# EasyEDA Pro project Access Control Core.eprj, schematic Card Reader

## Sheets
1 NFC Reader: Board Name: Card Reader; Create Date: 2026-01-15; Page Name: NFC Reader; Project Name: Access Control Core; Schematic Name: Card Reader; Update Date: 2026-01-20
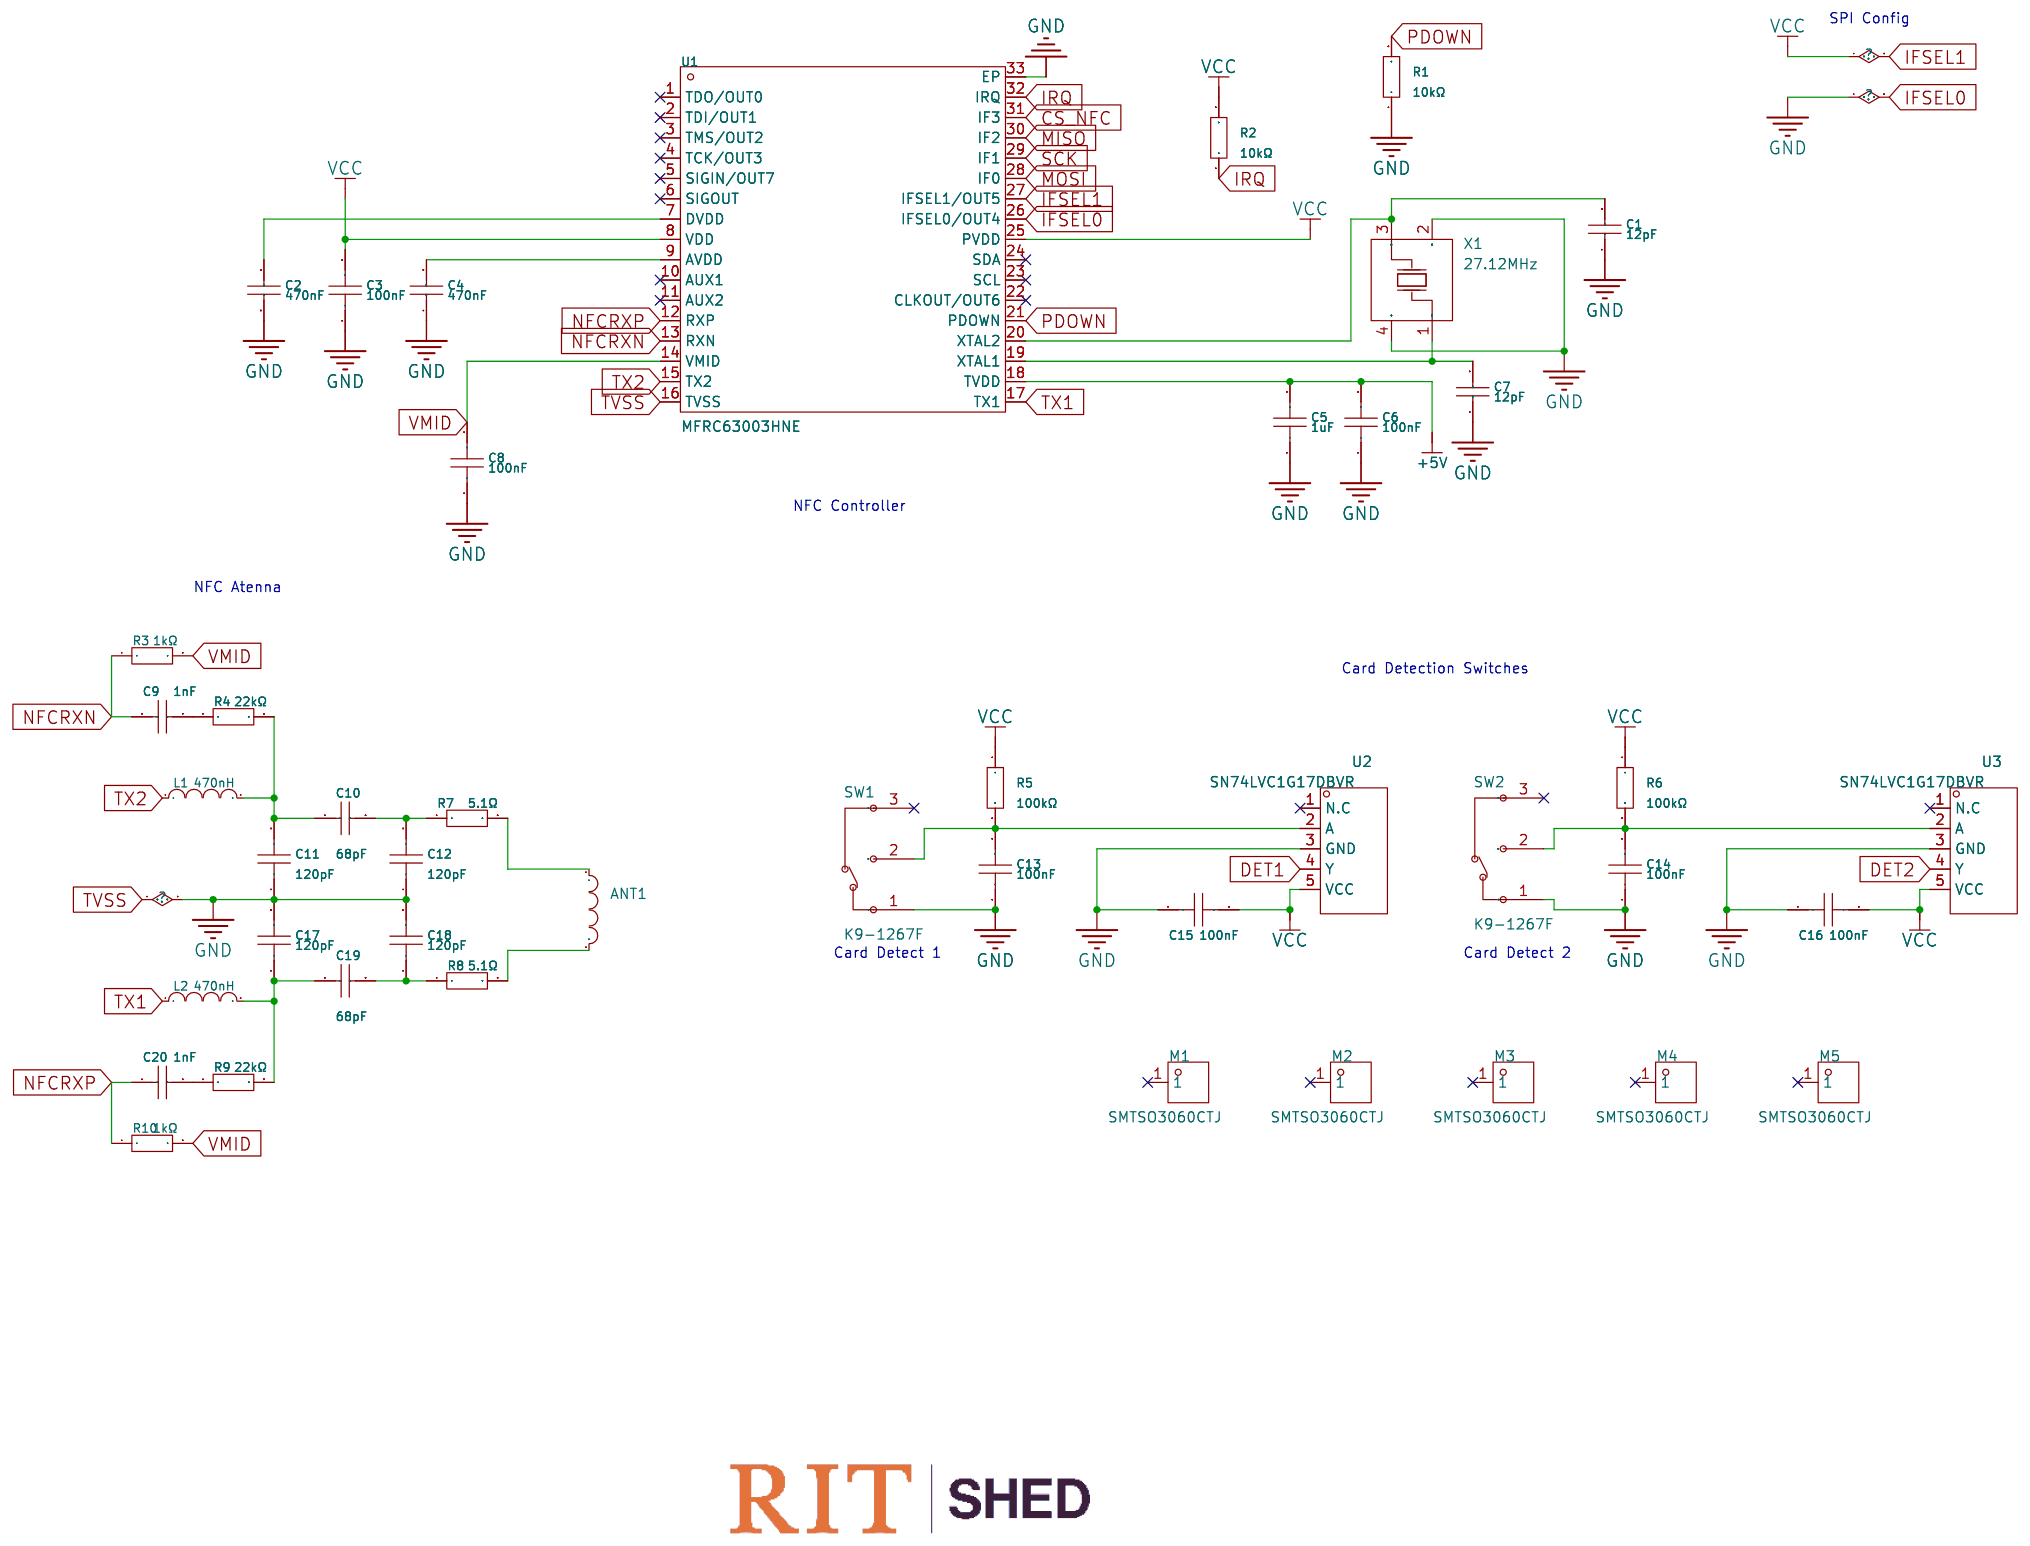
[diagram p0: NFC Reader]
2 Interfaces: Page Name: Interfaces; Update Date: 2026-01-21
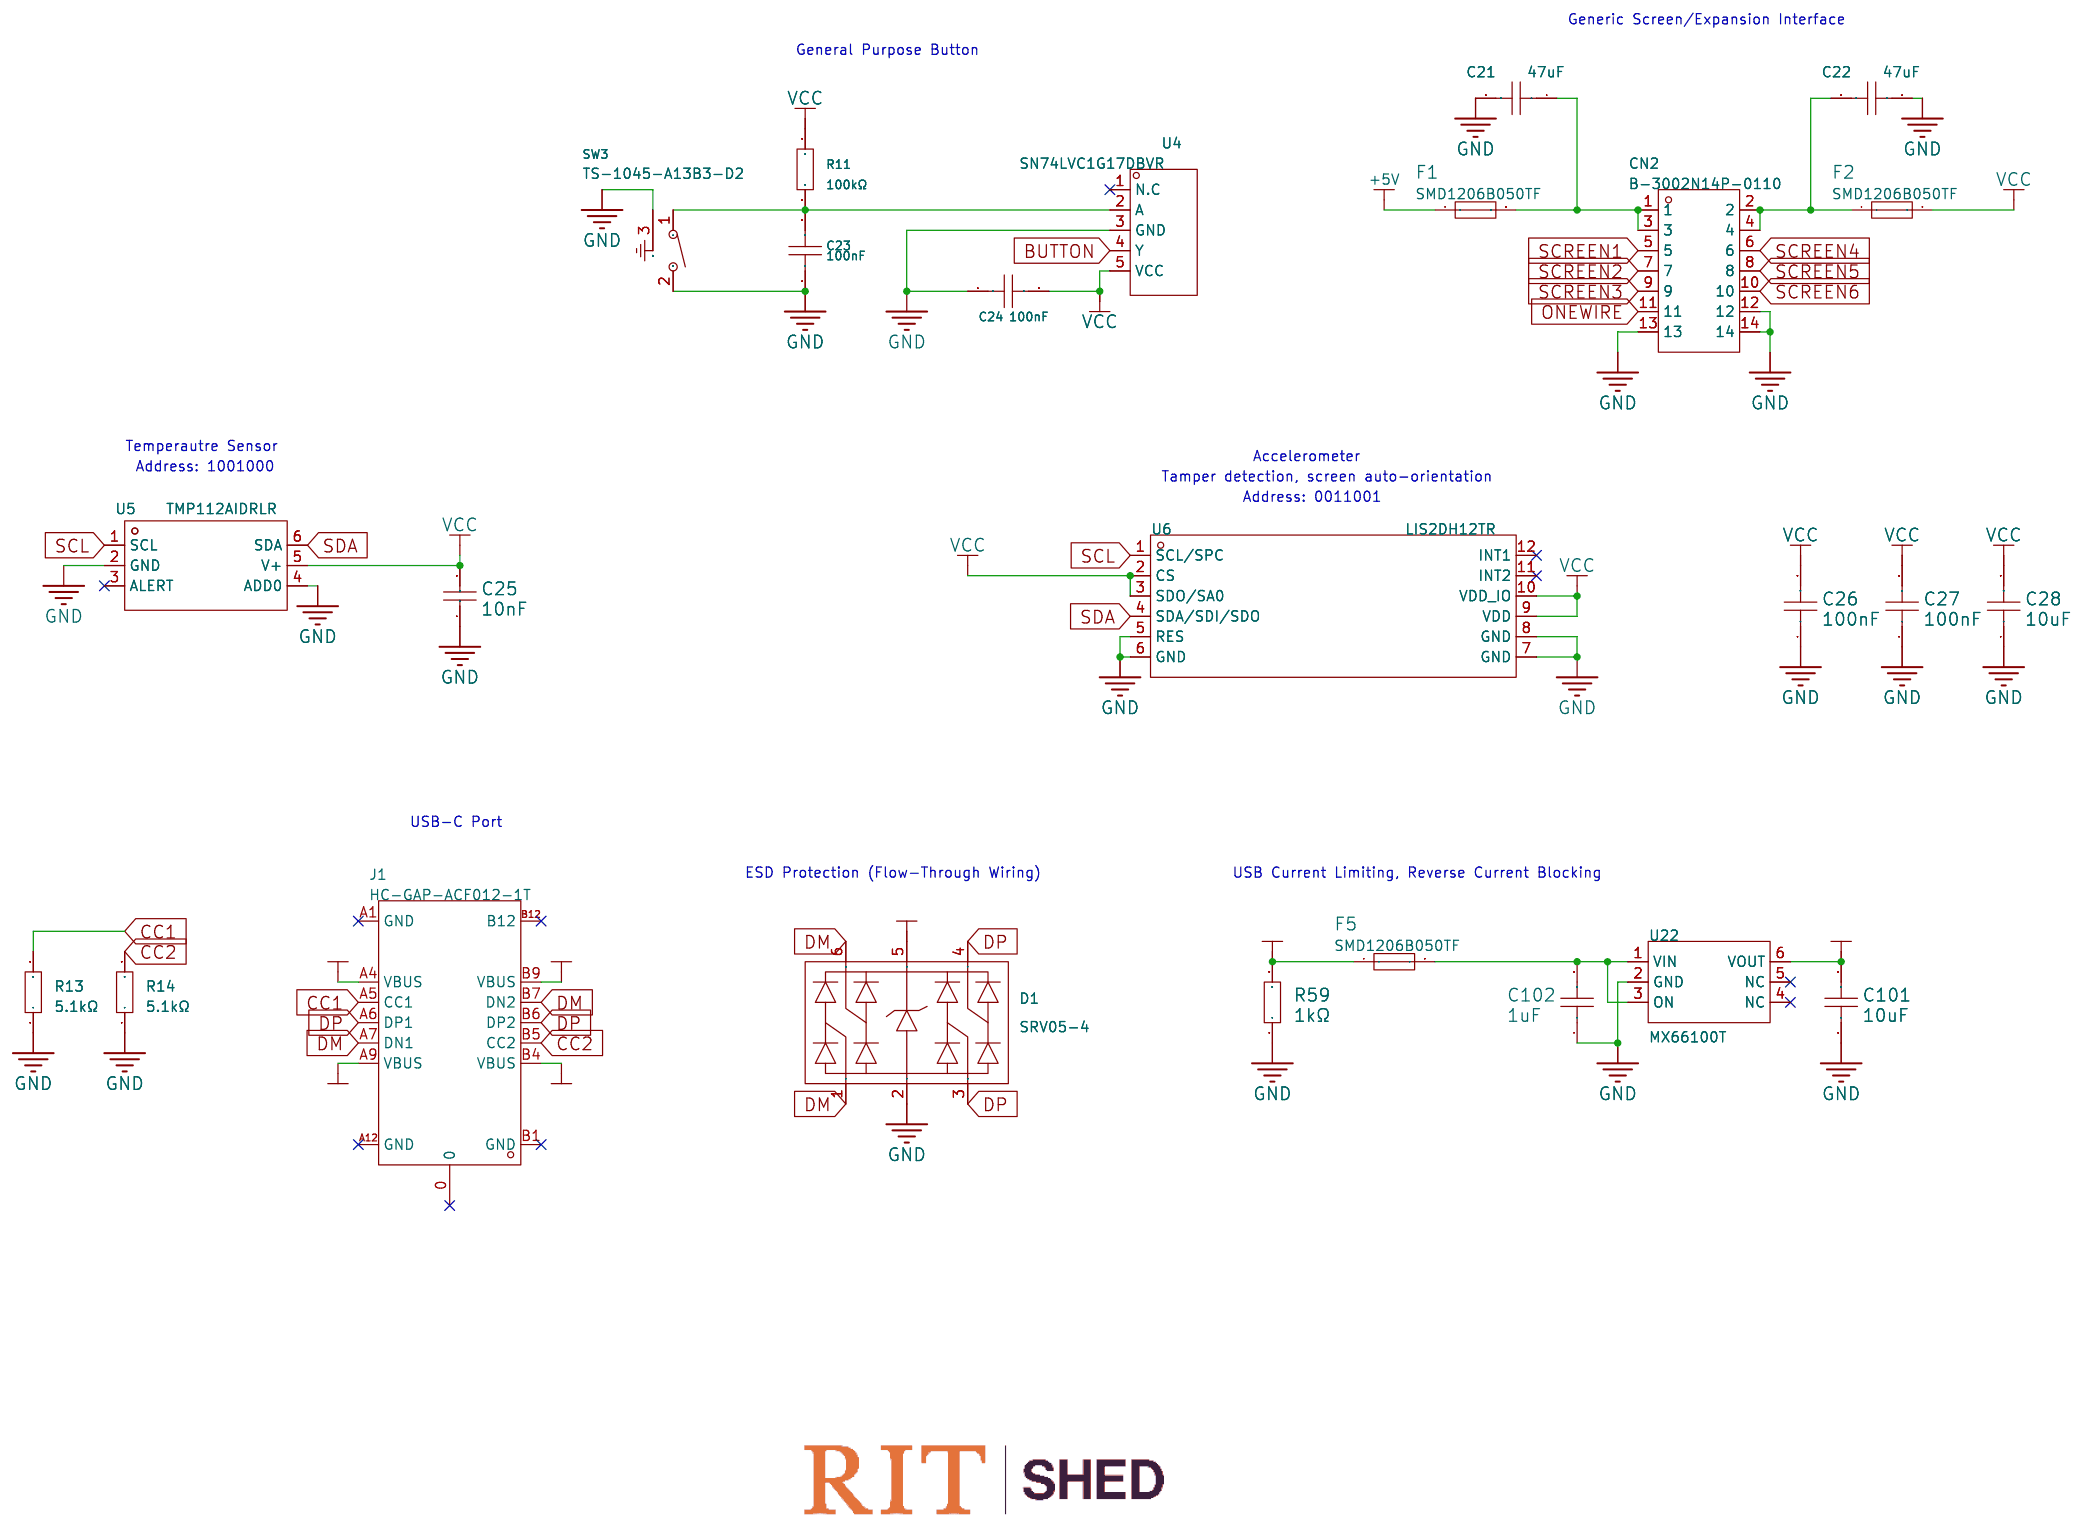
[diagram p1: Interfaces]
3 Bus Connection: Create Date: 2026-01-16; Page Name: Bus Connection; Update Date: 2026-01-19
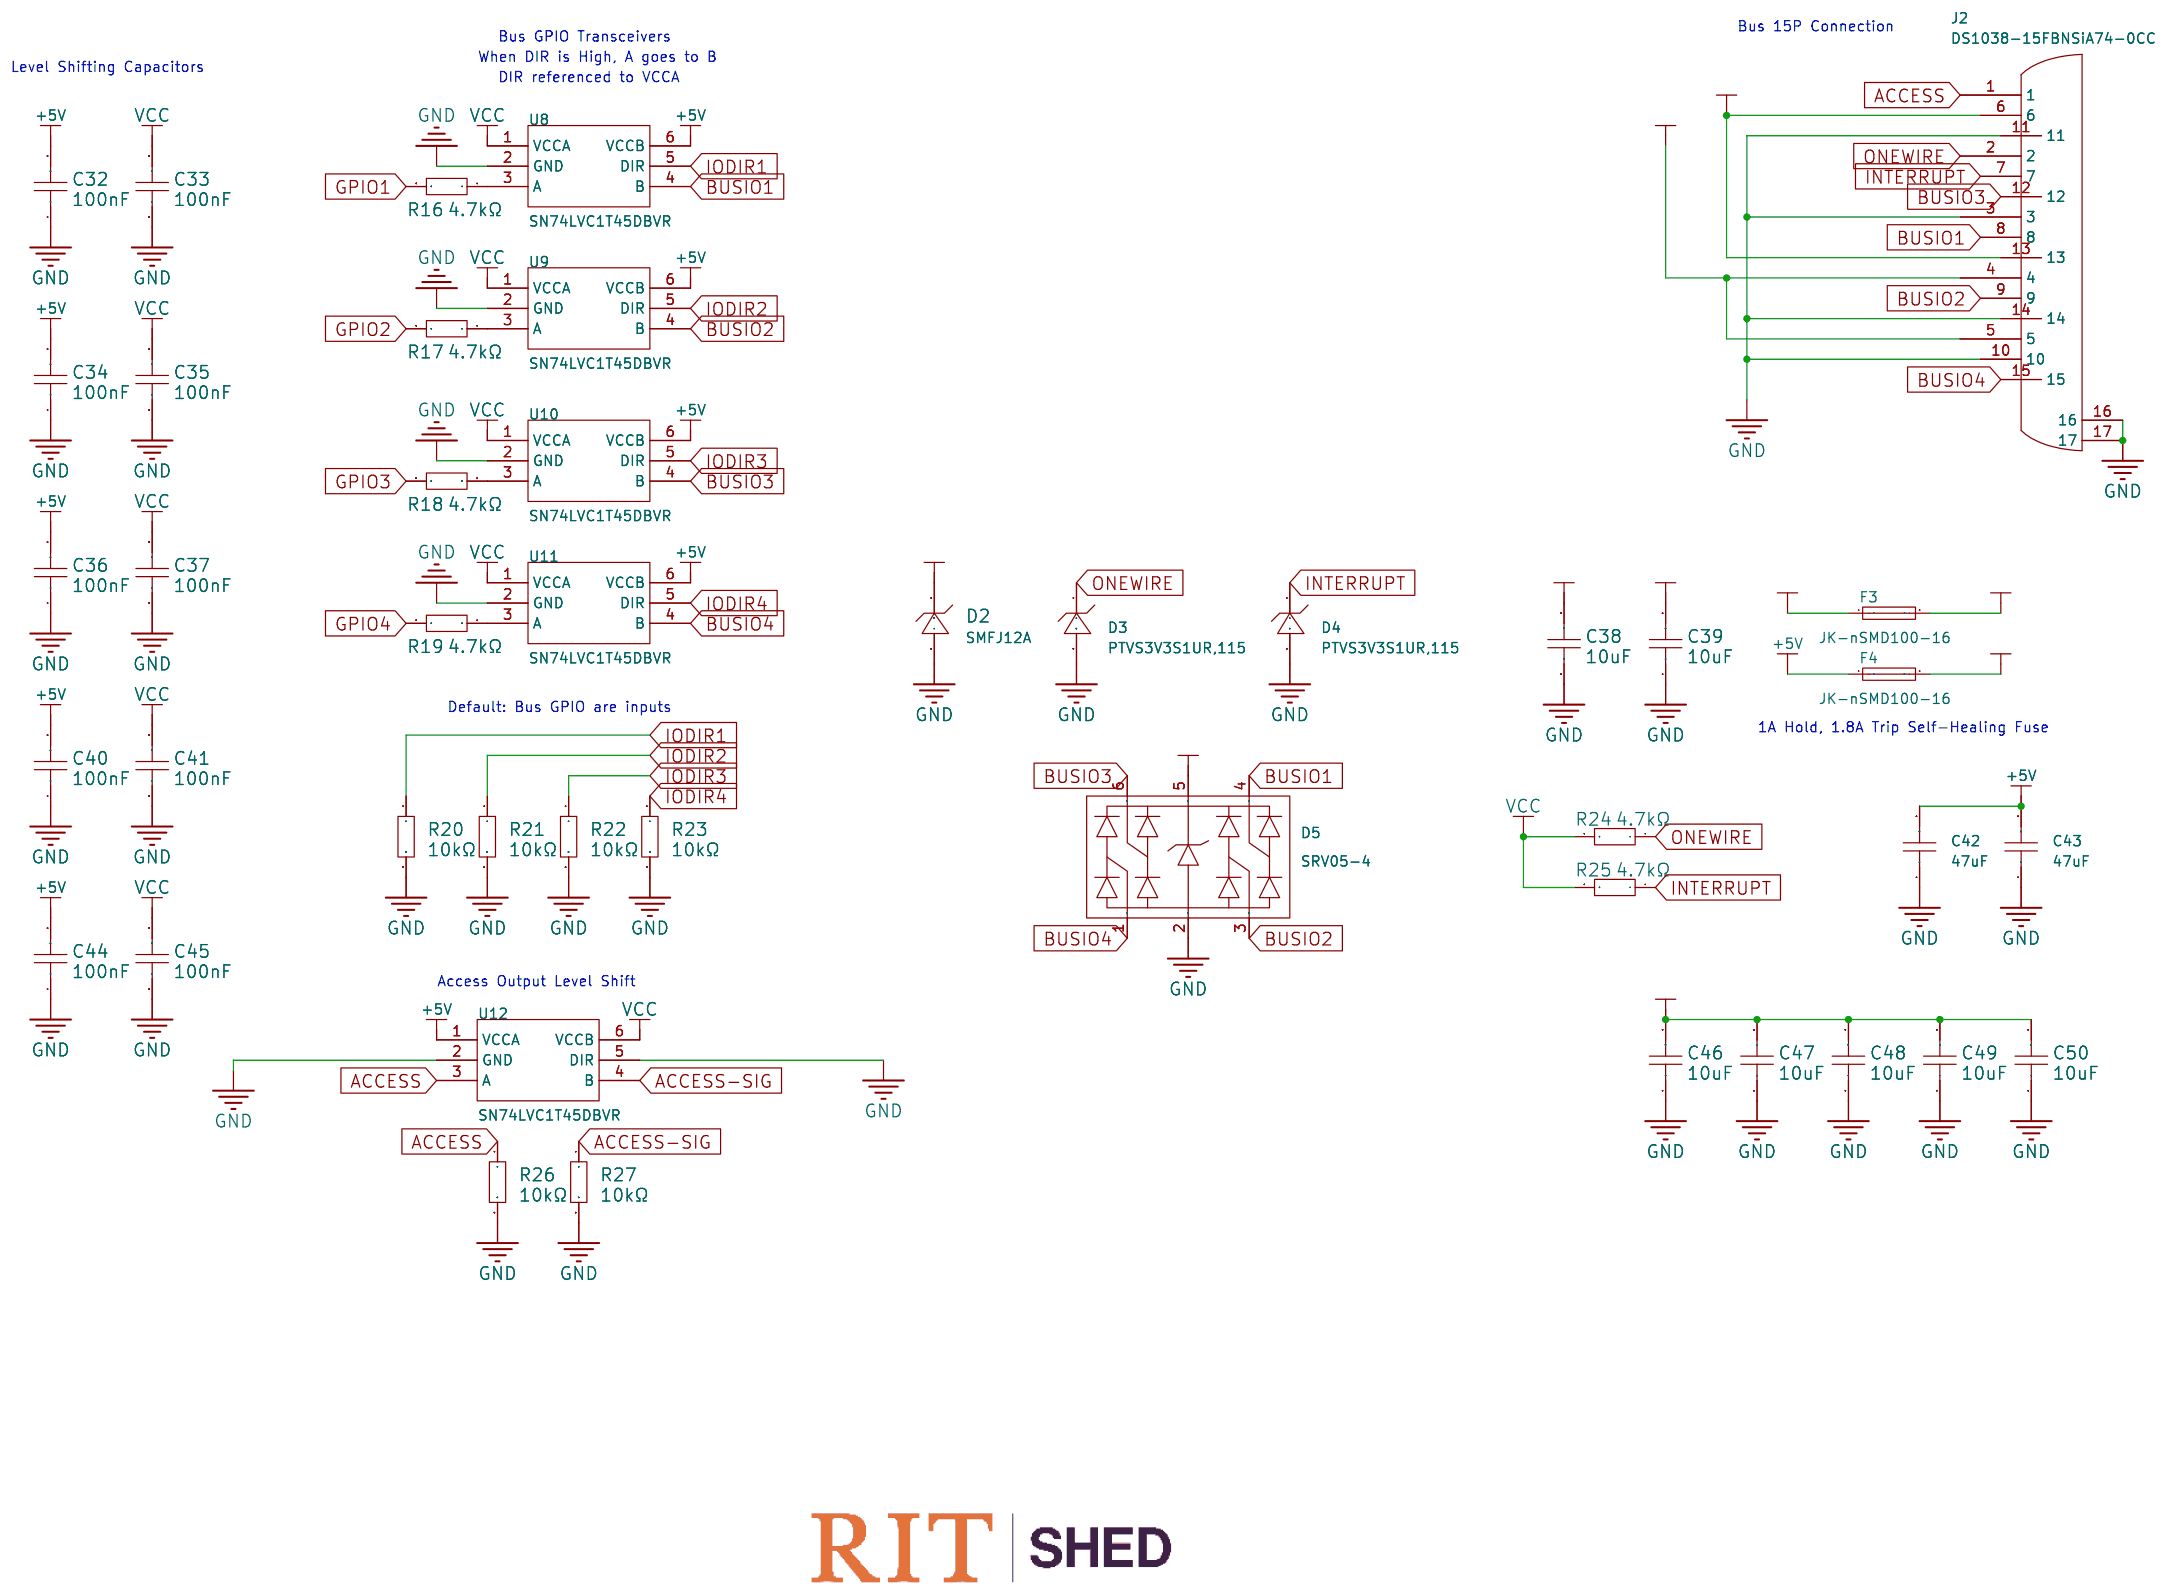
[diagram p2: Bus Connection]
4 Regulators: Create Date: 2026-01-16; Page Name: Regulators
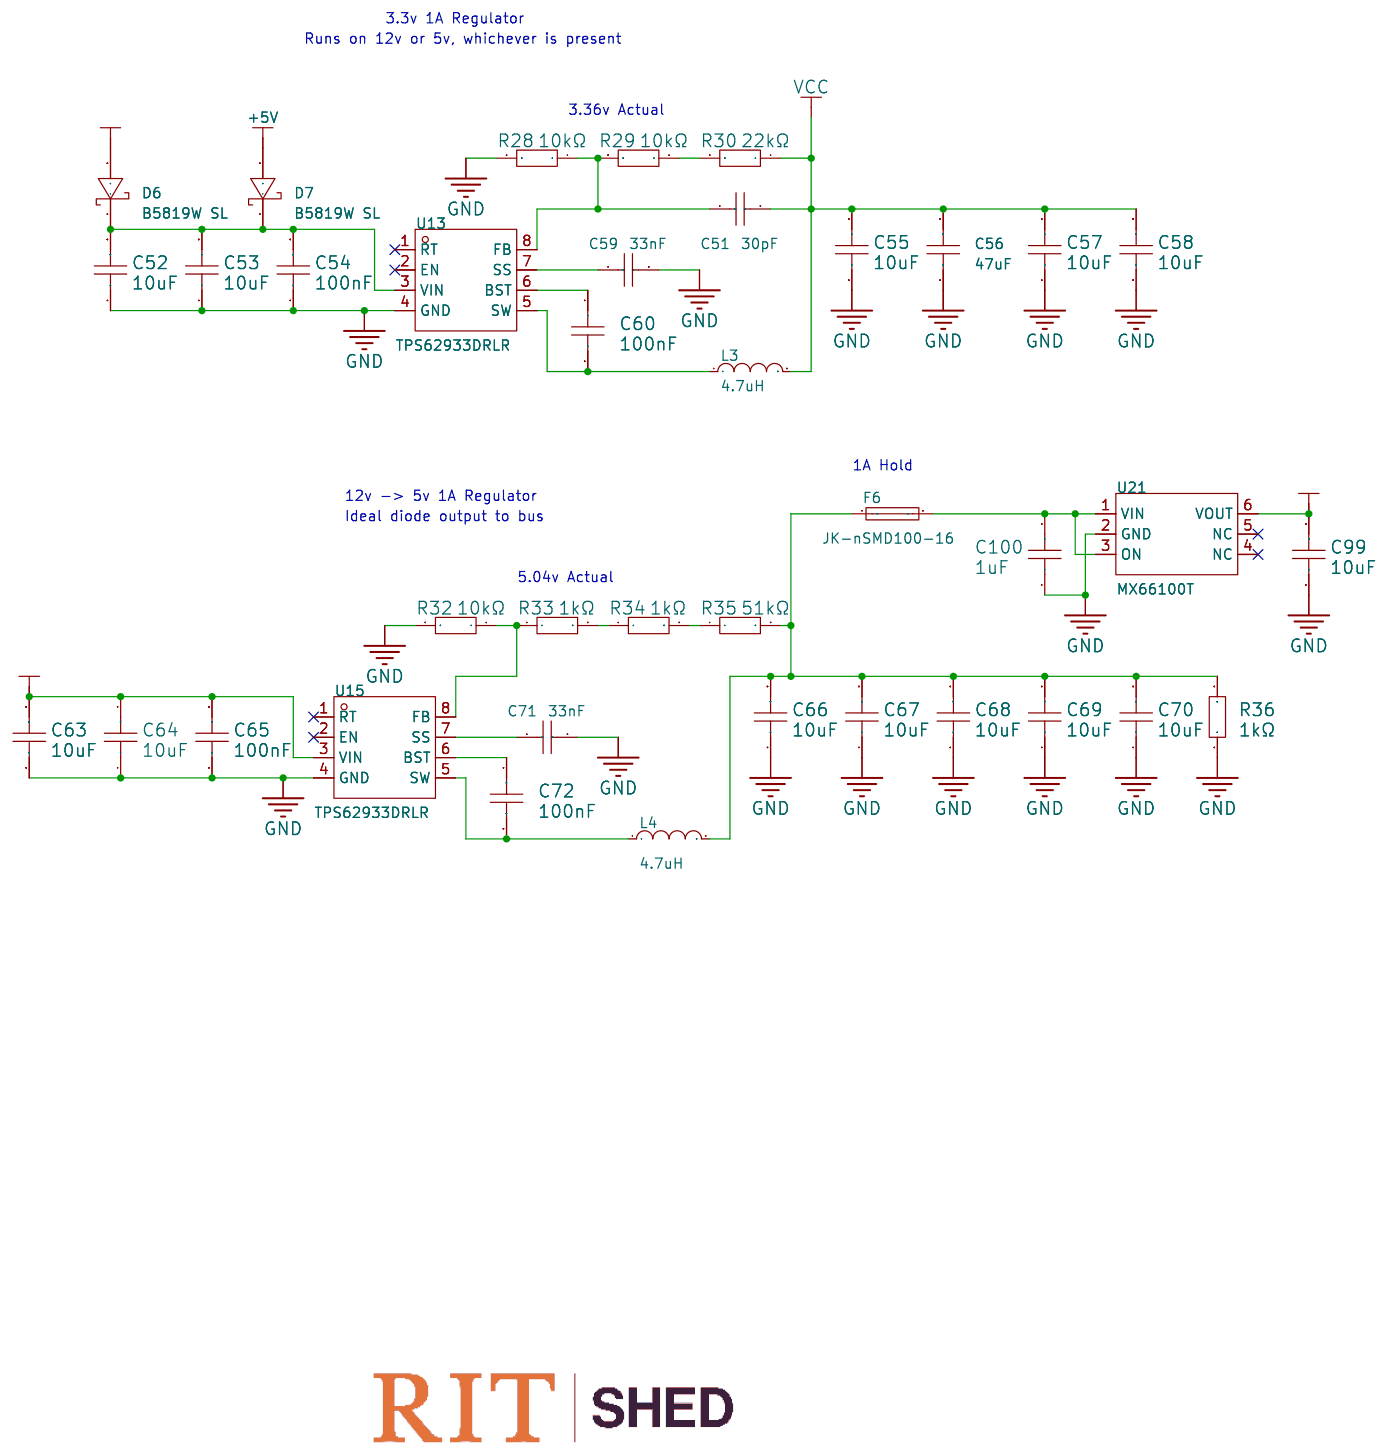
[diagram p3: Regulators]
5 Ethernet: Board Name: <System Assignment>; Create Date: 2026-01-16; Page Name: Ethernet; Update Date: 2026-01-19